# EasyEDA Pro project wukong01-Y003-HTOL - 2.eprj, board PCB1 (continued)
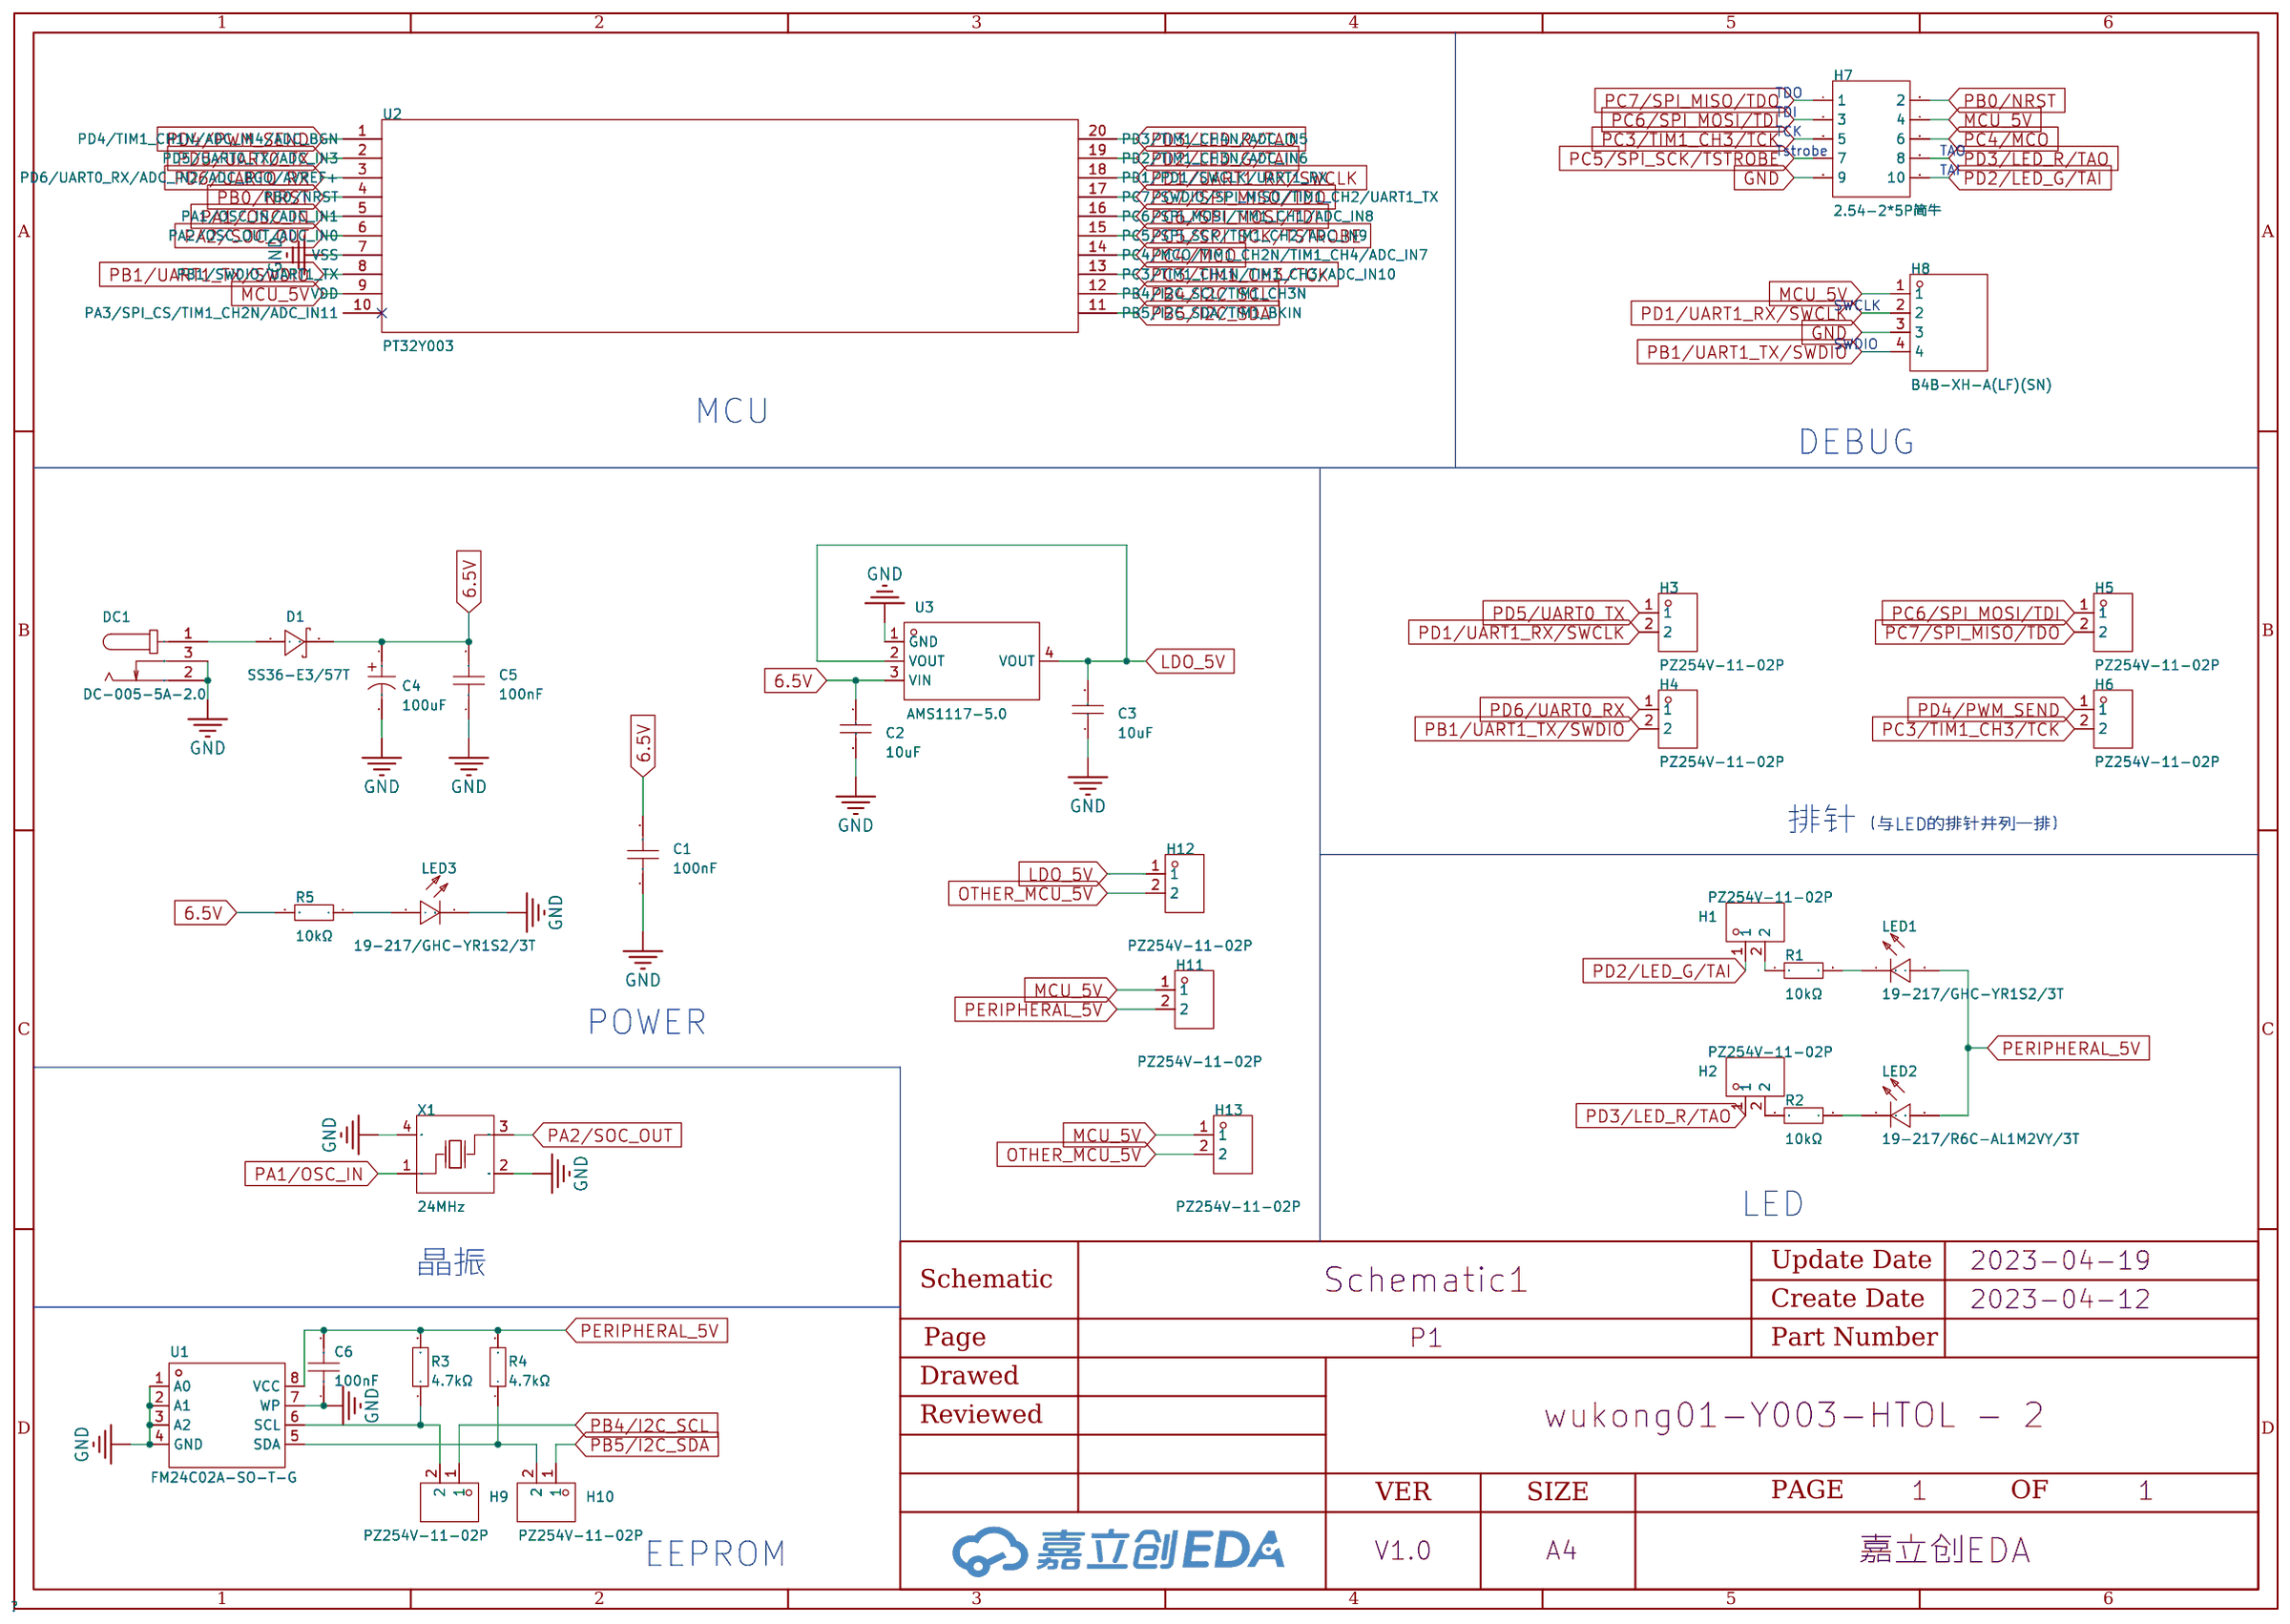
[diagram p0: schematic sheet]
## Routing (per net, layer and track width the routed paths; a pad name or vN(x,y) marks a point on that pad's centre or on a via; arc(x,y) is an arc through that point) (continued)
  vias: v1(15,192.23) v1(15,191.23) v1(15,190.23) v1(15,154.24) v1(15,153.24) v1(15,152.24) v1(15,116.23) v1(15,115.23) v1(15,114.23) v1(15,78.23) v1(15,77.23) v1(15,76.23) v1(16,192.23) v1(16,191.23) v1(16,190.23) v1(16,154.24) v1(16,153.24) v1(16,152.24) v1(16,116.23) v1(16,115.23) v1(16,114.23) v1(16,78.23) v1(16,77.23) v1(16,76.23) v1(17,192.23) v1(17,191.23) v1(17,190.23) v1(17,154.24) v1(17,153.24) v1(17,152.24) v1(17,116.23) v1(17,115.23) v1(17,114.23) v1(17,78.23) v1(17,77.23) v1(17,76.23) v1(55.77,180.81) v1(55.77,179.81) v1(55.77,178.81) v1(55.77,142.81) v1(55.77,141.81) v1(55.77,140.81) v1(55.77,104.8) v1(55.77,103.8) v1(55.77,102.8) v1(55.77,66.81) v1(55.77,65.81) v1(55.77,64.81) v1(55.9,192.11) v1(55.9,191.11) v1(55.9,190.11) v1(55.9,154.11) v1(55.9,153.11) v1(55.9,152.11) v1(55.9,116.11) v1(55.9,115.11) v1(55.9,114.11) v1(55.9,78.11) v1(55.9,77.11) v1(55.9,76.11) v1(56.77,180.81) v1(56.77,179.81) v1(56.77,178.81) v1(56.77,142.81) v1(56.77,141.81) v1(56.77,140.81) v1(56.77,104.8) v1(56.77,103.8) v1(56.77,102.8) v1(56.77,66.81) v1(56.77,65.81) v1(56.77,64.81) v1(56.9,192.11) v1(56.9,191.11) v1(56.9,190.11) v1(56.9,154.11) v1(56.9,153.11) v1(56.9,152.11) v1(56.9,116.11) v1(56.9,115.11) v1(56.9,114.11) v1(56.9,78.11) v1(56.9,77.11) v1(56.9,76.11) v1(57.77,180.81) v1(57.77,179.81) v1(57.77,178.81) v1(57.77,142.81) v1(57.77,141.81) v1(57.77,140.81) v1(57.77,104.8) v1(57.77,103.8) v1(57.77,102.8) v1(57.77,66.81) v1(57.77,65.81) v1(57.77,64.81) v1(57.9,192.11) v1(57.9,191.11) v1(57.9,190.11) v1(57.9,154.11) v1(57.9,153.11) v1(57.9,152.11) v1(57.9,116.11) v1(57.9,115.11) v1(57.9,114.11) v1(57.9,78.11) v1(57.9,77.11) v1(57.9,76.11) v1(60,230.23) v1(60,229.23) v1(60,228.23) v1(60,192.23) v1(60,191.23) v1(60,190.23) v1(60,154.24) v1(60,153.24) v1(60,152.24) v1(60,116.23) v1(60,115.23) v1(60,114.23) v1(60,78.23) v1(60,77.23) v1(60,76.23) v1(60,40.23) v1(60,39.23) v1(60,38.23) v1(61,230.23) v1(61,229.23) v1(61,228.23) v1(61,192.23) v1(61,191.23) v1(61,190.23) v1(61,154.24) v1(61,153.24) v1(61,152.24) v1(61,116.23) v1(61,115.23) v1(61,114.23) v1(61,78.23) v1(61,77.23) v1(61,76.23) v1(61,40.23) v1(61,39.23) v1(61,38.23) v1(62,230.23) v1(62,229.23) v1(62,228.23) v1(62,192.23) v1(62,191.23) v1(62,190.23) v1(62,154.24) v1(62,153.24) v1(62,152.24) v1(62,116.23) v1(62,115.23) v1(62,114.23) v1(62,78.23) v1(62,77.23) v1(62,76.23) v1(62,40.23) v1(62,39.23) v1(62,38.23) v1(100.77,218.81) v1(100.77,217.81) v1(100.77,216.81) v1(100.77,180.81) v1(100.77,179.81) v1(100.77,178.81) v1(100.77,142.81) v1(100.77,141.81) v1(100.77,140.81) v1(100.77,104.8) v1(100.77,103.8) v1(100.77,102.8) v1(100.77,66.81) v1(100.77,65.81) v1(100.77,64.81) v1(100.77,28.81) v1(100.77,27.81) v1(100.77,26.81) v1(100.9,230.11) v1(100.9,229.11) v1(100.9,228.11) v1(100.9,192.11) v1(100.9,191.11) v1(100.9,190.11) v1(100.9,154.11) v1(100.9,153.11) v1(100.9,152.11) v1(100.9,116.11) v1(100.9,115.11) v1(100.9,114.11) v1(100.9,78.11) v1(100.9,77.11) v1(100.9,76.11) v1(100.9,40.11) v1(100.9,39.11) v1(100.9,38.11) v1(101.77,218.81) v1(101.77,217.81) v1(101.77,216.81) v1(101.77,180.81) v1(101.77,179.81) v1(101.77,178.81) v1(101.77,142.81) v1(101.77,141.81) v1(101.77,140.81) v1(101.77,104.8) v1(101.77,103.8) v1(101.77,102.8) v1(101.77,66.81) v1(101.77,65.81) v1(101.77,64.81) v1(101.77,28.81) v1(101.77,27.81) v1(101.77,26.81) v1(101.9,230.11) v1(101.9,229.11) v1(101.9,228.11) v1(101.9,192.11) v1(101.9,191.11) v1(101.9,190.11) v1(101.9,154.11) v1(101.9,153.11) v1(101.9,152.11) v1(101.9,116.11) v1(101.9,115.11) v1(101.9,114.11) v1(101.9,78.11) v1(101.9,77.11) v1(101.9,76.11) v1(101.9,40.11) v1(101.9,39.11) v1(101.9,38.11) v1(102.77,218.81) v1(102.77,217.81) v1(102.77,216.81) v1(102.77,180.81) v1(102.77,179.81) v1(102.77,178.81) v1(102.77,142.81) v1(102.77,141.81) v1(102.77,140.81) v1(102.77,104.8) v1(102.77,103.8) v1(102.77,102.8) v1(102.77,66.81) v1(102.77,65.81) v1(102.77,64.81) v1(102.77,28.81) v1(102.77,27.81) v1(102.77,26.81) v1(102.9,230.11) v1(102.9,229.11) v1(102.9,228.11) v1(102.9,192.11) v1(102.9,191.11) v1(102.9,190.11) v1(102.9,154.11) v1(102.9,153.11) v1(102.9,152.11) v1(102.9,116.11) v1(102.9,115.11) v1(102.9,114.11) v1(102.9,78.11) v1(102.9,77.11) v1(102.9,76.11) v1(102.9,40.11) v1(102.9,39.11) v1(102.9,38.11) v1(105,230.23) v1(105,229.23) v1(105,228.23) v1(105,192.23) v1(105,191.23) v1(105,190.23) v1(105,154.24) v1(105,153.24) v1(105,152.24) v1(105,116.23) v1(105,115.23) v1(105,114.23) v1(105,78.23) v1(105,77.23) v1(105,76.23) v1(105,40.23) v1(105,39.23) v1(105,38.23) v1(106,230.23) v1(106,229.23) v1(106,228.23) v1(106,192.23) v1(106,191.23) v1(106,190.23) v1(106,154.24) v1(106,153.24) v1(106,152.24) v1(106,116.23) v1(106,115.23) v1(106,114.23) v1(106,78.23) v1(106,77.23) v1(106,76.23) v1(106,40.23) v1(106,39.23) v1(106,38.23) v1(107,230.23) v1(107,229.23) v1(107,228.23) v1(107,192.23) v1(107,191.23) v1(107,190.23) v1(107,154.24) v1(107,153.24) v1(107,152.24) v1(107,116.23) v1(107,115.23) v1(107,114.23) v1(107,78.23) v1(107,77.23) v1(107,76.23) v1(107,40.23) v1(107,39.23) v1(107,38.23) v1(145.77,218.81) v1(145.77,217.81) v1(145.77,216.81) v1(145.77,180.81) v1(145.77,179.81) v1(145.77,178.81) v1(145.77,142.81) v1(145.77,141.81) v1(145.77,140.81) v1(145.77,104.8) v1(145.77,103.8) v1(145.77,102.8) v1(145.77,66.81) v1(145.77,65.81) v1(145.77,64.81) v1(145.77,28.81) v1(145.77,27.81) v1(145.77,26.81) v1(145.9,230.11) v1(145.9,229.11) v1(145.9,228.11) v1(145.9,192.11) v1(145.9,191.11) v1(145.9,190.11) v1(145.9,154.11) v1(145.9,153.11) v1(145.9,152.11) v1(145.9,116.11) v1(145.9,115.11) v1(145.9,114.11) v1(145.9,78.11) v1(145.9,77.11) v1(145.9,76.11) v1(145.9,40.11) v1(145.9,39.11) v1(145.9,38.11) v1(146.77,218.81) v1(146.77,217.81) v1(146.77,216.81) v1(146.77,180.81) v1(146.77,179.81) v1(146.77,178.81) v1(146.77,142.81) v1(146.77,141.81) v1(146.77,140.81) v1(146.77,104.8) v1(146.77,103.8) v1(146.77,102.8) v1(146.77,66.81) v1(146.77,65.81) v1(146.77,64.81) v1(146.77,28.81) v1(146.77,27.81) v1(146.77,26.81) v1(146.9,230.11) v1(146.9,229.11) v1(146.9,228.11) v1(146.9,192.11) v1(146.9,191.11) v1(146.9,190.11) v1(146.9,154.11) v1(146.9,153.11) v1(146.9,152.11) v1(146.9,116.11) v1(146.9,115.11) v1(146.9,114.11) v1(146.9,78.11) v1(146.9,77.11) v1(146.9,76.11) v1(146.9,40.11) v1(146.9,39.11) v1(146.9,38.11) v1(147.77,218.81) v1(147.77,217.81) v1(147.77,216.81) v1(147.77,180.81) v1(147.77,179.81) v1(147.77,178.81) v1(147.77,142.81) v1(147.77,141.81) v1(147.77,140.81) v1(147.77,104.8) v1(147.77,103.8) v1(147.77,102.8) v1(147.77,66.81) v1(147.77,65.81) v1(147.77,64.81) v1(147.77,28.81) v1(147.77,27.81) v1(147.77,26.81) v1(147.9,230.11) v1(147.9,229.11) v1(147.9,228.11) v1(147.9,192.11) v1(147.9,191.11) v1(147.9,190.11) v1(147.9,154.11) v1(147.9,153.11) v1(147.9,152.11) v1(147.9,116.11) v1(147.9,115.11) v1(147.9,114.11) v1(147.9,78.11) v1(147.9,77.11) v1(147.9,76.11) v1(147.9,40.11) v1(147.9,39.11) v1(147.9,38.11) v1(150,230.23) v1(150,229.23) v1(150,228.23) v1(150,192.23) v1(150,191.23) v1(150,190.23) v1(150,154.24) v1(150,153.24) v1(150,152.24) v1(150,116.23) v1(150,115.23) v1(150,114.23) v1(150,78.23) v1(150,77.23) v1(150,76.23) v1(150,40.23) v1(150,39.23) v1(150,38.23) v1(151,230.23) v1(151,229.23) v1(151,228.23) v1(151,192.23) v1(151,191.23) v1(151,190.23) v1(151,154.24) v1(151,153.24) v1(151,152.24) v1(151,116.23) v1(151,115.23) v1(151,114.23) v1(151,78.23) v1(151,77.23) v1(151,76.23) v1(151,40.23) v1(151,39.23) v1(151,38.23) v1(152,230.23) v1(152,229.23) v1(152,228.23) v1(152,192.23) v1(152,191.23) v1(152,190.23) v1(152,154.24) v1(152,153.24) v1(152,152.24) v1(152,116.23) v1(152,115.23) v1(152,114.23) v1(152,78.23) v1(152,77.23) v1(152,76.23) v1(152,40.23) v1(152,39.23) v1(152,38.23) v1(190.77,218.81) v1(190.77,217.81) v1(190.77,216.81) v1(190.77,180.81) v1(190.77,179.81) v1(190.77,178.81) v1(190.77,142.81) v1(190.77,141.81) v1(190.77,140.81) v1(190.77,104.8) v1(190.77,103.8) v1(190.77,102.8) v1(190.77,66.81) v1(190.77,65.81) v1(190.77,64.81) v1(190.77,28.81) v1(190.77,27.81) v1(190.77,26.81) v1(190.9,230.11) v1(190.9,229.11) v1(190.9,228.11) v1(190.9,192.11) v1(190.9,191.11) v1(190.9,190.11) v1(190.9,154.11) v1(190.9,153.11) v1(190.9,152.11) v1(190.9,116.11) v1(190.9,115.11) v1(190.9,114.11) v1(190.9,78.11) v1(190.9,77.11) v1(190.9,76.11) v1(190.9,40.11) v1(190.9,39.11) v1(190.9,38.11) v1(191.77,218.81) v1(191.77,217.81) v1(191.77,216.81) v1(191.77,180.81) v1(191.77,179.81) v1(191.77,178.81) v1(191.77,142.81) v1(191.77,141.81) v1(191.77,140.81) v1(191.77,104.8) v1(191.77,103.8) v1(191.77,102.8) v1(191.77,66.81) v1(191.77,65.81) v1(191.77,64.81) v1(191.77,28.81) v1(191.77,27.81) v1(191.77,26.81) v1(191.9,230.11) v1(191.9,229.11) v1(191.9,228.11) v1(191.9,192.11) v1(191.9,191.11) v1(191.9,190.11) v1(191.9,154.11) v1(191.9,153.11) v1(191.9,152.11) v1(191.9,116.11) v1(191.9,115.11) v1(191.9,114.11) v1(191.9,78.11) v1(191.9,77.11) v1(191.9,76.11) v1(191.9,40.11) v1(191.9,39.11) v1(191.9,38.11) v1(192.77,218.81) v1(192.77,217.81) v1(192.77,216.81) v1(192.77,180.81) v1(192.77,179.81) v1(192.77,178.81) v1(192.77,142.81) v1(192.77,141.81) v1(192.77,140.81) v1(192.77,104.8) v1(192.77,103.8) v1(192.77,102.8) v1(192.77,66.81) v1(192.77,65.81) v1(192.77,64.81) v1(192.77,28.81) v1(192.77,27.81) v1(192.77,26.81) v1(192.9,230.11) v1(192.9,229.11) v1(192.9,228.11) v1(192.9,192.11) v1(192.9,191.11) v1(192.9,190.11) v1(192.9,154.11) v1(192.9,153.11) v1(192.9,152.11) v1(192.9,116.11) v1(192.9,115.11) v1(192.9,114.11) v1(192.9,78.11) v1(192.9,77.11) v1(192.9,76.11) v1(192.9,40.11) v1(192.9,39.11) v1(192.9,38.11) v1(195,230.23) v1(195,229.23) v1(195,228.23) v1(195,192.23) v1(195,191.23) v1(195,190.23) v1(195,154.24) v1(195,153.24) v1(195,152.24) v1(195,116.23) v1(195,115.23) v1(195,114.23) v1(195,78.23) v1(195,77.23) v1(195,76.23) v1(195,40.23) v1(195,39.23) v1(195,38.23) v1(196,230.23) v1(196,229.23) v1(196,228.23) v1(196,192.23) v1(196,191.23) v1(196,190.23) v1(196,154.24) v1(196,153.24) v1(196,152.24) v1(196,116.23) v1(196,115.23) v1(196,114.23) v1(196,78.23) v1(196,77.23) v1(196,76.23) v1(196,40.23) v1(196,39.23) v1(196,38.23) v1(197,230.23) v1(197,229.23) v1(197,228.23) v1(197,192.23) v1(197,191.23) v1(197,190.23) v1(197,154.24) v1(197,153.24) v1(197,152.24) v1(197,116.23) v1(197,115.23) v1(197,114.23) v1(197,78.23) v1(197,77.23) v1(197,76.23) v1(197,40.23) v1(197,39.23) v1(197,38.23) v1(235.77,218.81) v1(235.77,217.81) v1(235.77,216.81) v1(235.77,180.81) v1(235.77,179.81) v1(235.77,178.81) v1(235.77,142.81) v1(235.77,141.81) v1(235.77,140.81) v1(235.77,104.8) v1(235.77,103.8) v1(235.77,102.8) v1(235.77,66.81) v1(235.77,65.81) v1(235.77,64.81) v1(235.77,28.81) v1(235.77,27.81) v1(235.77,26.81) v1(235.9,230.11) v1(235.9,229.11) v1(235.9,228.11) v1(235.9,192.11) v1(235.9,191.11) v1(235.9,190.11) v1(235.9,154.11) v1(235.9,153.11) v1(235.9,152.11) v1(235.9,116.11) v1(235.9,115.11) v1(235.9,114.11) v1(235.9,78.11) v1(235.9,77.11) v1(235.9,76.11) v1(235.9,40.11) v1(235.9,39.11) v1(235.9,38.11) v1(236.77,218.81) v1(236.77,217.81) v1(236.77,216.81) v1(236.77,180.81) v1(236.77,179.81) v1(236.77,178.81) v1(236.77,142.81) v1(236.77,141.81) v1(236.77,140.81) v1(236.77,104.8) v1(236.77,103.8) v1(236.77,102.8) v1(236.77,66.81) v1(236.77,65.81) v1(236.77,64.81) v1(236.77,28.81) v1(236.77,27.81) v1(236.77,26.81) v1(236.9,230.11) v1(236.9,229.11) v1(236.9,228.11) v1(236.9,192.11) v1(236.9,191.11) v1(236.9,190.11) v1(236.9,154.11) v1(236.9,153.11) v1(236.9,152.11) v1(236.9,116.11) v1(236.9,115.11) v1(236.9,114.11) v1(236.9,78.11) v1(236.9,77.11) v1(236.9,76.11) v1(236.9,40.11) v1(236.9,39.11) v1(236.9,38.11) v1(237.77,218.81) v1(237.77,217.81) v1(237.77,216.81) v1(237.77,180.81) v1(237.77,179.81) v1(237.77,178.81) v1(237.77,142.81) v1(237.77,141.81) v1(237.77,140.81) v1(237.77,104.8) v1(237.77,103.8) v1(237.77,102.8) v1(237.77,66.81) v1(237.77,65.81) v1(237.77,64.81) v1(237.77,28.81) v1(237.77,27.81) v1(237.77,26.81) v1(237.9,230.11) v1(237.9,229.11) v1(237.9,228.11) v1(237.9,192.11) v1(237.9,191.11) v1(237.9,190.11) v1(237.9,154.11) v1(237.9,153.11) v1(237.9,152.11) v1(237.9,116.11) v1(237.9,115.11) v1(237.9,114.11) v1(237.9,78.11) v1(237.9,77.11) v1(237.9,76.11) v1(237.9,40.11) v1(237.9,39.11) v1(237.9,38.11) v1(240,192.23) v1(240,191.23) v1(240,190.23) v1(240,154.24) v1(240,153.24) v1(240,152.24) v1(240,116.23) v1(240,115.23) v1(240,114.23) v1(240,78.23) v1(240,77.23) v1(240,76.23) v1(241,192.23) v1(241,191.23) v1(241,190.23) v1(241,154.24) v1(241,153.24) v1(241,152.24) v1(241,116.23) v1(241,115.23) v1(241,114.23) v1(241,78.23) v1(241,77.23) v1(241,76.23) v1(242,192.23) v1(242,191.23) v1(242,190.23) v1(242,154.24) v1(242,153.24) v1(242,152.24) v1(242,116.23) v1(242,115.23) v1(242,114.23) v1(242,78.23) v1(242,77.23) v1(242,76.23) v1(280.77,180.81) v1(280.77,179.81) v1(280.77,178.81) v1(280.77,142.81) v1(280.77,141.81) v1(280.77,140.81) v1(280.77,104.8) v1(280.77,103.8) v1(280.77,102.8) v1(280.77,66.81) v1(280.77,65.81) v1(280.77,64.81) v1(280.9,192.11) v1(280.9,191.11) v1(280.9,190.11) v1(280.9,154.11) v1(280.9,153.11) v1(280.9,152.11) v1(280.9,116.11) v1(280.9,115.11) v1(280.9,114.11) v1(280.9,78.11) v1(280.9,77.11) v1(280.9,76.11) v1(281.77,180.81) v1(281.77,179.81) v1(281.77,178.81) v1(281.77,142.81) v1(281.77,141.81) v1(281.77,140.81) v1(281.77,104.8) v1(281.77,103.8) v1(281.77,102.8) v1(281.77,66.81) v1(281.77,65.81) v1(281.77,64.81) v1(281.9,192.11) v1(281.9,191.11) v1(281.9,190.11) v1(281.9,154.11) v1(281.9,153.11) v1(281.9,152.11) v1(281.9,116.11) v1(281.9,115.11) v1(281.9,114.11) v1(281.9,78.11) v1(281.9,77.11) v1(281.9,76.11) v1(282.77,180.81) v1(282.77,179.81) v1(282.77,178.81) v1(282.77,142.81) v1(282.77,141.81) v1(282.77,140.81) v1(282.77,104.8) v1(282.77,103.8) v1(282.77,102.8) v1(282.77,66.81) v1(282.77,65.81) v1(282.77,64.81) v1(282.9,192.11) v1(282.9,191.11) v1(282.9,190.11) v1(282.9,154.11) v1(282.9,153.11) v1(282.9,152.11) v1(282.9,116.11) v1(282.9,115.11) v1(282.9,114.11) v1(282.9,78.11) v1(282.9,77.11) v1(282.9,76.11)
LDO_5V: length 28.6
  Top Layer w0.5: U3#2.4 29.2,202.82 22.66,202.82 ; U3#4.4 54.41,226.82 C3#4.2 54.48,223.39 H12#4.1 ; U3.4 11.95,202.56 5.41,202.56 ; U3#3.4 47.43,202.95 40.89,202.95
MCU_5V: length 1914.7
  Top Layer w0.5: U2#10.9 31.79,171.3 29.59,171.3 ; H13#17.1 H11#18.1 133.43,90.98 132,92.41 120.91,92.41 119.59,93.73 119.59,95.3 ; v1(127.21,69.87) v1(127.21,66.57) ; 74.59,19.3 74.59,17.73 75.91,16.41 87,16.41 88.43,14.98 H11#31.1 H13#31.1 ; 74.59,19.3 76.79,19.3 U2#29.9 ; 74.59,19.3 v1(71.04,19.3) ; U2#5.9 76.79,171.3 74.59,171.3 ; 209.59,57.3 v1(206.03,57.3) ; 209.59,57.3 211.79,57.3 U2#26.9 ; 209.59,57.3 209.59,55.73 210.91,54.41 222,54.41 223.43,52.98 H11#23.1 H13#25.1 ; v1(217.21,69.87) v1(217.21,66.57) ; 164.59,57.3 v1(161.03,57.3) ; 164.59,57.3 164.59,55.73 165.91,54.41 177,54.41 178.43,52.98 H11#26.1 H13#27.1 ; 164.59,57.3 166.79,57.3 U2#25.9 ; H13#23.1 H11#24.1 133.43,52.98 132,54.41 120.91,54.41 119.59,55.73 119.59,57.3 ; v1(217.21,31.87) v1(217.21,28.57) ; 74.59,171.3 74.59,169.73 75.91,168.41 87,168.41 88.43,166.98 H11#7.1 H13#8.1 ; 74.59,171.3 v1(71.04,171.3) ; 74.59,133.3 v1(71.04,133.3) ; 74.59,133.3 74.59,131.74 75.91,130.41 87,130.41 88.43,128.98 H11#13.1 H13#14.1 ; 74.59,133.3 76.79,133.3 U2#11.9 ; 164.59,95.3 164.59,93.73 165.91,92.41 177,92.41 178.43,90.98 H11#20.1 H13#21.1 ; 164.59,95.3 v1(161.03,95.3) ; 164.59,95.3 166.79,95.3 U2#19.9 ; 119.59,133.3 121.79,133.3 U2#12.9 ; 119.59,133.3 119.59,131.74 120.91,130.41 132,130.41 133.43,128.98 H11#12.1 H13#11.1 ; 119.59,133.3 v1(116.04,133.3) ; 209.59,133.3 209.59,131.74 210.91,130.41 222,130.41 223.43,128.98 H11#11.1 H13#13.1 ; 209.59,133.3 211.79,133.3 U2#14.9 ; 209.59,133.3 v1(206.03,133.3) ; H13#32.1 H11#32.1 178.43,14.98 177,16.41 165.91,16.41 164.59,17.73 164.59,19.3 ; 119.59,171.3 121.79,171.3 U2#6.9 ; 119.59,171.3 119.59,169.73 120.91,168.41 132,168.41 133.43,166.98 H11#6.1 H13#5.1 ; 119.59,171.3 v1(116.04,171.3) ; v1(127.21,183.87) v1(127.21,180.57) ; v1(217.21,183.87) v1(217.21,180.57) ; 29.59,171.3 29.59,169.73 30.91,168.41 42,168.41 43.43,166.98 H11#10.1 H13#10.1 ; 29.59,171.3 v1(26.04,171.3) ; 74.59,95.3 v1(71.04,95.3) ; 74.59,95.3 74.59,93.73 75.91,92.41 87,92.41 88.43,90.98 H11#19.1 H13#20.1 ; 74.59,95.3 76.79,95.3 U2#17.9 ; v1(262.21,107.87) v1(262.21,104.57) ; 164.59,133.3 164.59,131.74 165.91,130.41 177,130.41 178.43,128.98 H11#14.1 H13#15.1 ; 164.59,133.3 v1(161.03,133.3) ; 164.59,133.3 166.79,133.3 U2#13.9 ; 164.59,209.3 166.79,209.3 U2#3.9 ; 164.59,209.3 v1(161.03,209.3) ; 164.59,209.3 164.59,207.73 165.91,206.41 177,206.41 178.43,204.98 H11#3.1 H13#3.1 ; v1(262.21,69.87) v1(262.21,66.57) ; v1(217.21,107.87) v1(217.21,104.57) ; 209.59,95.3 209.59,93.73 210.91,92.41 222,92.41 223.43,90.98 H11#17.1 H13#19.1 ; 209.59,95.3 211.79,95.3 U2#20.9 ; 209.59,95.3 v1(206.03,95.3) ; 119.59,209.3 121.79,209.3 U2#2.9 ; 119.59,209.3 119.59,207.73 120.91,206.41 132,206.41 133.43,204.98 H11#2.1 H13#2.1 ; 119.59,209.3 v1(116.04,209.3) ; 119.59,95.3 v1(116.04,95.3) ; 119.59,95.3 121.79,95.3 U2#18.9 ; 209.59,209.3 211.79,209.3 U2#4.9 ; 209.59,209.3 209.59,207.73 210.91,206.41 222,206.41 223.43,204.98 H11#4.1 H13#4.1 ; 209.59,209.3 v1(206.03,209.3) ; v1(172.21,107.87) v1(172.21,104.57) ; U2#7.9 166.79,171.3 164.59,171.3 ; U2#22.9 31.79,95.3 29.59,95.3 ; 29.59,57.3 31.79,57.3 U2#28.9 ; 29.59,57.3 29.59,55.73 30.91,54.41 42,54.41 43.43,52.98 H11#28.1 H13#28.1 ; 29.59,57.3 v1(26.04,57.3) ; v1(82.21,183.87) v1(82.21,180.57) ; U2#21.9 256.79,95.3 254.59,95.3 ; 254.59,95.3 254.59,93.73 255.91,92.41 267,92.41 268.43,90.98 H11#21.1 H13#18.1 ; 254.59,95.3 v1(251.03,95.3) ; 209.59,19.3 209.59,17.73 210.91,16.41 222,16.41 223.43,14.98 H11#29.1 H13#30.1 ; 209.59,19.3 v1(206.03,19.3) ; 209.59,19.3 211.79,19.3 U2#32.9 ; 164.59,19.3 166.79,19.3 U2#31.9 ; 164.59,19.3 v1(161.03,19.3) ; 254.59,171.3 256.79,171.3 U2#9.9 ; 254.59,171.3 254.59,169.73 255.91,168.41 267,168.41 268.43,166.98 H11#9.1 H13#6.1 ; 254.59,171.3 v1(251.03,171.3) ; 254.59,133.3 v1(251.03,133.3) ; 254.59,133.3 256.79,133.3 U2#15.9 ; 254.59,133.3 254.59,131.74 255.91,130.41 267,130.41 268.43,128.98 H11#15.1 H13#12.1 ; H13#29.1 H11#30.1 133.43,14.98 132,16.41 120.91,16.41 119.59,17.73 119.59,19.3 ; 254.59,57.3 254.59,55.73 255.91,54.41 267,54.41 268.43,52.98 H11#27.1 H13#24.1 ; 254.59,57.3 v1(251.03,57.3) ; 254.59,57.3 256.79,57.3 U2#27.9 ; 74.59,57.3 74.59,55.73 75.91,54.41 87,54.41 88.43,52.98 H11#25.1 H13#26.1 ; 74.59,57.3 76.79,57.3 U2#23.9 ; 74.59,57.3 v1(71.04,57.3) ; 164.59,171.3 v1(161.03,171.3) ; 164.59,171.3 164.59,169.73 165.91,168.41 177,168.41 178.43,166.98 H11#8.1 H13#9.1 ; v1(262.21,183.87) v1(262.21,180.57) ; v1(37.21,107.87) v1(37.21,104.57) ; 29.59,95.3 v1(26.04,95.3) ; 29.59,95.3 29.59,93.73 30.91,92.41 42,92.41 43.43,90.98 H11#22.1 H13#22.1 ; v1(172.21,183.87) v1(172.21,180.57) ; v1(217.21,145.87) v1(217.21,142.57) ; 74.59,209.3 v1(71.04,209.3) ; 74.59,209.3 76.79,209.3 U2.9 ; 74.59,209.3 74.59,207.73 75.91,206.41 87,206.41 88.43,204.98 H11.1 H13.1 ; U2#30.9 121.79,19.3 119.59,19.3 ; 119.59,57.3 121.79,57.3 U2#24.9 ; 119.59,57.3 v1(116.04,57.3) ; v1(127.21,221.87) v1(127.21,218.57) ; U2#8.9 211.79,171.3 209.59,171.3 ; 209.59,171.3 v1(206.03,171.3) ; 209.59,171.3 209.59,169.73 210.91,168.41 222,168.41 223.43,166.98 H11#5.1 H13#7.1 ; v1(127.21,145.87) v1(127.21,142.57) ; v1(172.21,221.87) v1(172.21,218.57) ; v1(37.21,183.87) v1(37.21,180.57) ; H13#16.1 H11#16.1 43.43,128.98 42,130.41 30.91,130.41 29.59,131.74 29.59,133.3 ; v1(82.21,69.87) v1(82.21,66.57) ; v1(172.21,31.87) v1(172.21,28.57) ; v1(217.21,221.87) v1(217.21,218.57) ; v1(172.21,145.87) v1(172.21,142.57) ; v1(262.21,145.87) v1(262.21,142.57) ; 29.59,133.3 v1(26.04,133.3) ; 29.59,133.3 31.79,133.3 U2#16.9 ; 119.59,19.3 v1(116.04,19.3) ; v1(37.21,69.87) v1(37.21,66.57) ; v1(82.21,31.87) v1(82.21,28.57) ; v1(37.21,145.87) v1(37.21,142.57) ; v1(82.21,107.87) v1(82.21,104.57) ; v1(82.21,221.87) v1(82.21,218.57) ; v1(82.21,145.87) v1(82.21,142.57) ; v1(127.21,31.87) v1(127.21,28.57) ; v1(127.21,107.87) v1(127.21,104.57) ; v1(172.21,69.87) v1(172.21,66.57)
  Bottom Layer w0.5: 116.04,142.44 127.08,142.44 v1(127.21,142.57) ; 116.04,142.44 H8#12.1 ; 116.04,142.44 v1(116.04,133.3) ; v1(71.04,57.3) 71.04,66.44 ; 71.04,66.44 H8#23.1 ; 71.04,66.44 82.08,66.44 v1(82.21,66.57) ; v1(116.04,57.3) 116.04,66.44 ; 116.04,66.44 127.08,66.44 v1(127.21,66.57) ; 116.04,66.44 H8#24.1 ; v1(262.21,142.57) 262.08,142.44 251.03,142.44 ; v1(217.21,180.57) 217.08,180.44 206.03,180.44 ; 161.03,28.44 172.08,28.44 v1(172.21,28.57) ; 161.03,28.44 H8#32.1 ; 161.03,28.44 v1(161.03,19.3) ; 116.04,104.44 H8#18.1 ; 116.04,104.44 v1(116.04,95.3) ; 116.04,104.44 127.08,104.44 v1(127.21,104.57) ; v1(82.21,28.57) 82.08,28.44 71.04,28.44 ; v1(71.04,209.3) 71.04,218.44 ; 71.04,218.44 H8.1 ; 71.04,218.44 82.08,218.44 v1(82.21,218.57) ; 161.03,180.44 172.08,180.44 v1(172.21,180.57) ; 161.03,180.44 H8#9.1 ; 161.03,180.44 v1(161.03,171.3) ; v1(217.21,142.57) 217.08,142.44 206.03,142.44 ; v1(37.21,66.57) 37.08,66.44 26.04,66.44 ; v1(161.03,133.3) 161.03,142.44 ; 161.03,142.44 172.08,142.44 v1(172.21,142.57) ; 161.03,142.44 H8#15.1 ; 206.03,142.44 H8#13.1 ; 206.03,142.44 v1(206.03,133.3) ; v1(262.21,104.57) 262.08,104.44 251.03,104.44 ; v1(37.21,180.57) 37.08,180.44 26.04,180.44 ; 206.03,28.44 217.08,28.44 v1(217.21,28.57) ; 206.03,28.44 v1(206.03,19.3) ; 206.03,28.44 H8#31.1 ; 161.03,104.44 H8#21.1 ; 161.03,104.44 172.08,104.44 v1(172.21,104.57) ; 161.03,104.44 v1(161.03,95.3) ; v1(26.04,57.3) 26.04,66.44 ; 26.04,66.44 H8#26.1 ; v1(82.21,180.57) 82.08,180.44 71.04,180.44 ; 206.03,218.44 217.08,218.44 v1(217.21,218.57) ; 206.03,218.44 v1(206.03,209.3) ; 206.03,218.44 H8#4.1 ; v1(71.04,95.3) 71.04,104.44 ; 71.04,104.44 H8#17.1 ; 71.04,104.44 82.08,104.44 v1(82.21,104.57) ; 71.04,142.44 H8#11.1 ; 71.04,142.44 v1(71.04,133.3) ; 71.04,142.44 82.08,142.44 v1(82.21,142.57) ; 26.04,180.44 H8#8.1 ; 26.04,180.44 v1(26.04,171.3) ; 116.04,180.44 127.08,180.44 v1(127.21,180.57) ; 116.04,180.44 H8#6.1 ; 116.04,180.44 v1(116.04,171.3) ; 206.03,180.44 H8#7.1 ; 206.03,180.44 v1(206.03,171.3) ; v1(217.21,66.57) 217.08,66.44 206.03,66.44 ; 251.03,142.44 H8#16.1 ; 251.03,142.44 v1(251.03,133.3) ; 251.03,104.44 H8#22.1 ; 251.03,104.44 v1(251.03,95.3) ; v1(127.21,28.57) 127.08,28.44 116.04,28.44 ; 116.04,28.44 v1(116.04,19.3) ; 116.04,28.44 H8#30.1 ; v1(26.04,95.3) 26.04,104.44 ; 26.04,104.44 37.08,104.44 v1(37.21,104.57) ; 26.04,104.44 H8#20.1 ; v1(217.21,104.57) 217.08,104.44 206.03,104.44 ; 26.04,142.44 37.08,142.44 v1(37.21,142.57) ; 26.04,142.44 H8#14.1 ; 26.04,142.44 v1(26.04,133.3) ; 71.04,28.44 H8#29.1 ; 71.04,28.44 v1(71.04,19.3) ; 116.04,218.44 127.08,218.44 v1(127.21,218.57) ; 116.04,218.44 v1(116.04,209.3) ; 116.04,218.44 H8#2.1 ; 206.03,66.44 H8#25.1 ; 206.03,66.44 v1(206.03,57.3) ; 251.03,66.44 H8#28.1 ; 251.03,66.44 v1(251.03,57.3) ; 251.03,66.44 262.08,66.44 v1(262.21,66.57) ; 161.03,218.44 172.08,218.44 v1(172.21,218.57) ; 161.03,218.44 v1(161.03,209.3) ; 161.03,218.44 H8#3.1 ; v1(262.21,180.57) 262.08,180.44 251.03,180.44 ; v1(161.03,57.3) 161.03,66.44 ; 161.03,66.44 172.08,66.44 v1(172.21,66.57) ; 161.03,66.44 H8#27.1 ; 71.04,180.44 H8#5.1 ; 71.04,180.44 v1(71.04,171.3) ; 251.03,180.44 v1(251.03,171.3) ; 251.03,180.44 H8#10.1 ; 206.03,104.44 H8#19.1 ; 206.03,104.44 v1(206.03,95.3)
